# EAGLE board Resistor_Resistor (EAGLE 8.3.0), part 30 of 32
## Placement (x,y rotation side) (continued)
R36676  10K  [0201]  248.46,46.99 0 top
R36677  10K  [0201]  248.46,47.6 0 top
R36678  10K  [0201]  248.46,48.21 0 top
R36679  10K  [0201]  248.46,48.82 0 top
R36680  10K  [0201]  248.46,49.43 0 top
R36681  10K  [0201]  248.46,50.04 0 top
R36682  10K  [0201]  248.46,50.65 0 top
R36683  10K  [0201]  248.46,51.26 0 top
R36684  10K  [0201]  248.46,51.87 0 top
R36685  10K  [0201]  248.46,52.48 0 top
R36686  10K  [0201]  248.46,53.09 0 top
R36687  10K  [0201]  248.46,53.7 0 top
R36688  10K  [0201]  248.46,54.31 0 top
R36689  10K  [0201]  248.46,54.91 0 top
R36690  10K  [0201]  248.46,55.52 0 top
R36691  10K  [0201]  248.46,56.13 0 top
R36692  10K  [0201]  248.46,56.74 0 top
R36693  10K  [0201]  248.46,57.35 0 top
R36694  10K  [0201]  248.46,57.96 0 top
R36695  10K  [0201]  248.46,58.57 0 top
R36696  10K  [0201]  248.46,59.18 0 top
R36697  10K  [0201]  248.46,59.79 0 top
R36698  10K  [0201]  248.46,60.4 0 top
R36699  10K  [0201]  248.46,61.01 0 top
R36700  10K  [0201]  248.46,61.62 0 top
R36701  10K  [0201]  248.46,62.23 0 top
R36702  10K  [0201]  248.46,62.84 0 top
R36703  10K  [0201]  248.46,63.45 0 top
R36704  10K  [0201]  248.46,64.06 0 top
R36705  10K  [0201]  248.46,64.67 0 top
R36706  10K  [0201]  248.46,65.28 0 top
R36707  10K  [0201]  248.46,65.89 0 top
R36708  10K  [0201]  248.46,66.5 0 top
R36709  10K  [0201]  248.46,67.11 0 top
R36710  10K  [0201]  248.46,67.72 0 top
R36711  10K  [0201]  248.46,68.33 0 top
R36712  10K  [0201]  248.46,68.94 0 top
R36713  10K  [0201]  248.46,69.55 0 top
R36714  10K  [0201]  248.46,70.15 0 top
R36715  10K  [0201]  248.46,70.76 0 top
R36716  10K  [0201]  248.46,71.37 0 top
R36717  10K  [0201]  248.46,71.98 0 top
R36718  10K  [0201]  248.46,72.59 0 top
R36719  10K  [0201]  248.46,73.2 0 top
R36720  10K  [0201]  248.46,73.81 0 top
R36721  10K  [0201]  248.46,74.42 0 top
R36722  10K  [0201]  248.46,75.03 0 top
R36723  10K  [0201]  248.46,75.64 0 top
R36724  10K  [0201]  248.46,76.25 0 top
R36725  10K  [0201]  248.46,76.86 0 top
R36726  10K  [0201]  248.46,77.47 0 top
R36727  10K  [0201]  248.46,78.08 0 top
R36728  10K  [0201]  248.46,78.69 0 top
R36729  10K  [0201]  248.46,79.3 0 top
R36730  10K  [0201]  248.46,79.91 0 top
R36731  10K  [0201]  248.46,80.52 0 top
R36732  10K  [0201]  248.46,81.13 0 top
R36733  10K  [0201]  248.46,81.74 0 top
R36734  10K  [0201]  248.46,82.35 0 top
R36735  10K  [0201]  248.46,82.96 0 top
R36736  10K  [0201]  248.46,83.57 0 top
R36737  10K  [0201]  248.46,84.18 0 top
R36738  10K  [0201]  248.46,84.79 0 top
R36739  10K  [0201]  248.46,85.39 0 top
R36740  10K  [0201]  248.46,86 0 top
R36741  10K  [0201]  248.46,86.61 0 top
R36742  10K  [0201]  248.46,87.22 0 top
R36743  10K  [0201]  248.46,87.83 0 top
R36744  10K  [0201]  248.46,88.44 0 top
R36745  10K  [0201]  248.46,89.05 0 top
R36746  10K  [0201]  248.46,89.66 0 top
R36747  10K  [0201]  248.46,90.27 0 top
R36748  10K  [0201]  248.46,90.88 0 top
R36749  10K  [0201]  248.46,91.49 0 top
R36750  10K  [0201]  248.46,92.1 0 top
R36751  10K  [0201]  248.46,92.71 0 top
R36752  10K  [0201]  248.46,93.32 0 top
R36753  10K  [0201]  248.46,93.93 0 top
R36754  10K  [0201]  248.46,94.54 0 top
R36755  10K  [0201]  248.46,95.15 0 top
R36756  10K  [0201]  248.46,95.76 0 top
R36757  10K  [0201]  248.46,96.37 0 top
R36758  10K  [0201]  248.46,96.98 0 top
R36759  10K  [0201]  248.46,97.59 0 top
R36760  10K  [0201]  248.46,98.2 0 top
R36761  10K  [0201]  248.46,98.81 0 top
R36762  10K  [0201]  248.46,99.42 0 top
R36763  10K  [0201]  248.46,100.03 0 top
R36764  10K  [0201]  248.46,100.63 0 top
R36765  10K  [0201]  248.46,101.24 0 top
R36766  10K  [0201]  248.46,101.85 0 top
R36767  10K  [0201]  248.46,102.46 0 top
R36768  10K  [0201]  248.46,103.07 0 top
R36769  10K  [0201]  248.46,103.68 0 top
R36770  10K  [0201]  248.46,104.29 0 top
R36771  10K  [0201]  248.46,104.9 0 top
R36772  10K  [0201]  248.46,105.51 0 top
R36773  10K  [0201]  248.46,106.12 0 top
R36774  10K  [0201]  248.46,106.73 0 top
R36775  10K  [0201]  248.46,107.34 0 top
R36776  10K  [0201]  248.46,107.95 0 top
R36777  10K  [0201]  248.46,108.56 0 top
R36778  10K  [0201]  248.46,109.17 0 top
R36779  10K  [0201]  248.46,109.78 0 top
R36780  10K  [0201]  248.46,110.39 0 top
R36781  10K  [0201]  248.46,111 0 top
R36782  10K  [0201]  248.46,111.61 0 top
R36783  10K  [0201]  248.46,112.22 0 top
R36784  10K  [0201]  248.46,112.83 0 top
R36785  10K  [0201]  248.46,113.44 0 top
R36786  10K  [0201]  248.46,114.05 0 top
R36787  10K  [0201]  248.46,114.66 0 top
R36788  10K  [0201]  248.46,115.27 0 top
R36789  10K  [0201]  248.46,115.87 0 top
R36790  10K  [0201]  248.46,116.48 0 top
R36791  10K  [0201]  248.46,117.09 0 top
R36792  10K  [0201]  248.46,117.7 0 top
R36793  10K  [0201]  248.46,118.31 0 top
R36794  10K  [0201]  248.46,118.92 0 top
R36795  10K  [0201]  248.46,119.53 0 top
R36796  10K  [0201]  248.46,120.14 0 top
R36797  10K  [0201]  248.46,120.75 0 top
R36798  10K  [0201]  248.46,121.36 0 top
R36799  10K  [0201]  248.46,121.97 0 top
R36800  10K  [0201]  248.46,122.58 0 top
R36801  10K  [0201]  249.68,1.27 0 top
R36802  10K  [0201]  249.68,1.88 0 top
R36803  10K  [0201]  249.68,2.49 0 top
R36804  10K  [0201]  249.68,3.1 0 top
R36805  10K  [0201]  249.68,3.71 0 top
R36806  10K  [0201]  249.68,4.32 0 top
R36807  10K  [0201]  249.68,4.93 0 top
R36808  10K  [0201]  249.68,5.54 0 top
R36809  10K  [0201]  249.68,6.15 0 top
R36810  10K  [0201]  249.68,6.76 0 top
R36811  10K  [0201]  249.68,7.37 0 top
R36812  10K  [0201]  249.68,7.98 0 top
R36813  10K  [0201]  249.68,8.59 0 top
R36814  10K  [0201]  249.68,9.19 0 top
R36815  10K  [0201]  249.68,9.8 0 top
R36816  10K  [0201]  249.68,10.41 0 top
R36817  10K  [0201]  249.68,11.02 0 top
R36818  10K  [0201]  249.68,11.63 0 top
R36819  10K  [0201]  249.68,12.24 0 top
R36820  10K  [0201]  249.68,12.85 0 top
R36821  10K  [0201]  249.68,13.46 0 top
R36822  10K  [0201]  249.68,14.07 0 top
R36823  10K  [0201]  249.68,14.68 0 top
R36824  10K  [0201]  249.68,15.29 0 top
R36825  10K  [0201]  249.68,15.9 0 top
R36826  10K  [0201]  249.68,16.51 0 top
R36827  10K  [0201]  249.68,17.12 0 top
R36828  10K  [0201]  249.68,17.73 0 top
R36829  10K  [0201]  249.68,18.34 0 top
R36830  10K  [0201]  249.68,18.95 0 top
R36831  10K  [0201]  249.68,19.56 0 top
R36832  10K  [0201]  249.68,20.17 0 top
R36833  10K  [0201]  249.68,20.78 0 top
R36834  10K  [0201]  249.68,21.39 0 top
R36835  10K  [0201]  249.68,22 0 top
R36836  10K  [0201]  249.68,22.61 0 top
R36837  10K  [0201]  249.68,23.22 0 top
R36838  10K  [0201]  249.68,23.83 0 top
R36839  10K  [0201]  249.68,24.43 0 top
R36840  10K  [0201]  249.68,25.04 0 top
R36841  10K  [0201]  249.68,25.65 0 top
R36842  10K  [0201]  249.68,26.26 0 top
R36843  10K  [0201]  249.68,26.87 0 top
R36844  10K  [0201]  249.68,27.48 0 top
R36845  10K  [0201]  249.68,28.09 0 top
R36846  10K  [0201]  249.68,28.7 0 top
R36847  10K  [0201]  249.68,29.31 0 top
R36848  10K  [0201]  249.68,29.92 0 top
R36849  10K  [0201]  249.68,30.53 0 top
R36850  10K  [0201]  249.68,31.14 0 top
R36851  10K  [0201]  249.68,31.75 0 top
R36852  10K  [0201]  249.68,32.36 0 top
R36853  10K  [0201]  249.68,32.97 0 top
R36854  10K  [0201]  249.68,33.58 0 top
R36855  10K  [0201]  249.68,34.19 0 top
R36856  10K  [0201]  249.68,34.8 0 top
R36857  10K  [0201]  249.68,35.41 0 top
R36858  10K  [0201]  249.68,36.02 0 top
R36859  10K  [0201]  249.68,36.63 0 top
R36860  10K  [0201]  249.68,37.24 0 top
R36861  10K  [0201]  249.68,37.85 0 top
R36862  10K  [0201]  249.68,38.46 0 top
R36863  10K  [0201]  249.68,39.07 0 top
R36864  10K  [0201]  249.68,39.67 0 top
R36865  10K  [0201]  249.68,40.28 0 top
R36866  10K  [0201]  249.68,40.89 0 top
R36867  10K  [0201]  249.68,41.5 0 top
R36868  10K  [0201]  249.68,42.11 0 top
R36869  10K  [0201]  249.68,42.72 0 top
R36870  10K  [0201]  249.68,43.33 0 top
R36871  10K  [0201]  249.68,43.94 0 top
R36872  10K  [0201]  249.68,44.55 0 top
R36873  10K  [0201]  249.68,45.16 0 top
R36874  10K  [0201]  249.68,45.77 0 top
R36875  10K  [0201]  249.68,46.38 0 top
R36876  10K  [0201]  249.68,46.99 0 top
R36877  10K  [0201]  249.68,47.6 0 top
R36878  10K  [0201]  249.68,48.21 0 top
R36879  10K  [0201]  249.68,48.82 0 top
R36880  10K  [0201]  249.68,49.43 0 top
R36881  10K  [0201]  249.68,50.04 0 top
R36882  10K  [0201]  249.68,50.65 0 top
R36883  10K  [0201]  249.68,51.26 0 top
R36884  10K  [0201]  249.68,51.87 0 top
R36885  10K  [0201]  249.68,52.48 0 top
R36886  10K  [0201]  249.68,53.09 0 top
R36887  10K  [0201]  249.68,53.7 0 top
R36888  10K  [0201]  249.68,54.31 0 top
R36889  10K  [0201]  249.68,54.91 0 top
R36890  10K  [0201]  249.68,55.52 0 top
R36891  10K  [0201]  249.68,56.13 0 top
R36892  10K  [0201]  249.68,56.74 0 top
R36893  10K  [0201]  249.68,57.35 0 top
R36894  10K  [0201]  249.68,57.96 0 top
R36895  10K  [0201]  249.68,58.57 0 top
R36896  10K  [0201]  249.68,59.18 0 top
R36897  10K  [0201]  249.68,59.79 0 top
R36898  10K  [0201]  249.68,60.4 0 top
R36899  10K  [0201]  249.68,61.01 0 top
R36900  10K  [0201]  249.68,61.62 0 top
R36901  10K  [0201]  249.68,62.23 0 top
R36902  10K  [0201]  249.68,62.84 0 top
R36903  10K  [0201]  249.68,63.45 0 top
R36904  10K  [0201]  249.68,64.06 0 top
R36905  10K  [0201]  249.68,64.67 0 top
R36906  10K  [0201]  249.68,65.28 0 top
R36907  10K  [0201]  249.68,65.89 0 top
R36908  10K  [0201]  249.68,66.5 0 top
R36909  10K  [0201]  249.68,67.11 0 top
R36910  10K  [0201]  249.68,67.72 0 top
R36911  10K  [0201]  249.68,68.33 0 top
R36912  10K  [0201]  249.68,68.94 0 top
R36913  10K  [0201]  249.68,69.55 0 top
R36914  10K  [0201]  249.68,70.15 0 top
R36915  10K  [0201]  249.68,70.76 0 top
R36916  10K  [0201]  249.68,71.37 0 top
R36917  10K  [0201]  249.68,71.98 0 top
R36918  10K  [0201]  249.68,72.59 0 top
R36919  10K  [0201]  249.68,73.2 0 top
R36920  10K  [0201]  249.68,73.81 0 top
R36921  10K  [0201]  249.68,74.42 0 top
R36922  10K  [0201]  249.68,75.03 0 top
R36923  10K  [0201]  249.68,75.64 0 top
R36924  10K  [0201]  249.68,76.25 0 top
R36925  10K  [0201]  249.68,76.86 0 top
R36926  10K  [0201]  249.68,77.47 0 top
R36927  10K  [0201]  249.68,78.08 0 top
R36928  10K  [0201]  249.68,78.69 0 top
R36929  10K  [0201]  249.68,79.3 0 top
R36930  10K  [0201]  249.68,79.91 0 top
R36931  10K  [0201]  249.68,80.52 0 top
R36932  10K  [0201]  249.68,81.13 0 top
R36933  10K  [0201]  249.68,81.74 0 top
R36934  10K  [0201]  249.68,82.35 0 top
R36935  10K  [0201]  249.68,82.96 0 top
R36936  10K  [0201]  249.68,83.57 0 top
R36937  10K  [0201]  249.68,84.18 0 top
R36938  10K  [0201]  249.68,84.79 0 top
R36939  10K  [0201]  249.68,85.39 0 top
R36940  10K  [0201]  249.68,86 0 top
R36941  10K  [0201]  249.68,86.61 0 top
R36942  10K  [0201]  249.68,87.22 0 top
R36943  10K  [0201]  249.68,87.83 0 top
R36944  10K  [0201]  249.68,88.44 0 top
R36945  10K  [0201]  249.68,89.05 0 top
R36946  10K  [0201]  249.68,89.66 0 top
R36947  10K  [0201]  249.68,90.27 0 top
R36948  10K  [0201]  249.68,90.88 0 top
R36949  10K  [0201]  249.68,91.49 0 top
R36950  10K  [0201]  249.68,92.1 0 top
R36951  10K  [0201]  249.68,92.71 0 top
R36952  10K  [0201]  249.68,93.32 0 top
R36953  10K  [0201]  249.68,93.93 0 top
R36954  10K  [0201]  249.68,94.54 0 top
R36955  10K  [0201]  249.68,95.15 0 top
R36956  10K  [0201]  249.68,95.76 0 top
R36957  10K  [0201]  249.68,96.37 0 top
R36958  10K  [0201]  249.68,96.98 0 top
R36959  10K  [0201]  249.68,97.59 0 top
R36960  10K  [0201]  249.68,98.2 0 top
R36961  10K  [0201]  249.68,98.81 0 top
R36962  10K  [0201]  249.68,99.42 0 top
R36963  10K  [0201]  249.68,100.03 0 top
R36964  10K  [0201]  249.68,100.63 0 top
R36965  10K  [0201]  249.68,101.24 0 top
R36966  10K  [0201]  249.68,101.85 0 top
R36967  10K  [0201]  249.68,102.46 0 top
R36968  10K  [0201]  249.68,103.07 0 top
R36969  10K  [0201]  249.68,103.68 0 top
R36970  10K  [0201]  249.68,104.29 0 top
R36971  10K  [0201]  249.68,104.9 0 top
R36972  10K  [0201]  249.68,105.51 0 top
R36973  10K  [0201]  249.68,106.12 0 top
R36974  10K  [0201]  249.68,106.73 0 top
R36975  10K  [0201]  249.68,107.34 0 top
R36976  10K  [0201]  249.68,107.95 0 top
R36977  10K  [0201]  249.68,108.56 0 top
R36978  10K  [0201]  249.68,109.17 0 top
R36979  10K  [0201]  249.68,109.78 0 top
R36980  10K  [0201]  249.68,110.39 0 top
R36981  10K  [0201]  249.68,111 0 top
R36982  10K  [0201]  249.68,111.61 0 top
R36983  10K  [0201]  249.68,112.22 0 top
R36984  10K  [0201]  249.68,112.83 0 top
R36985  10K  [0201]  249.68,113.44 0 top
R36986  10K  [0201]  249.68,114.05 0 top
R36987  10K  [0201]  249.68,114.66 0 top
R36988  10K  [0201]  249.68,115.27 0 top
R36989  10K  [0201]  249.68,115.87 0 top
R36990  10K  [0201]  249.68,116.48 0 top
R36991  10K  [0201]  249.68,117.09 0 top
R36992  10K  [0201]  249.68,117.7 0 top
R36993  10K  [0201]  249.68,118.31 0 top
R36994  10K  [0201]  249.68,118.92 0 top
R36995  10K  [0201]  249.68,119.53 0 top
R36996  10K  [0201]  249.68,120.14 0 top
R36997  10K  [0201]  249.68,120.75 0 top
R36998  10K  [0201]  249.68,121.36 0 top
R36999  10K  [0201]  249.68,121.97 0 top
R37000  10K  [0201]  249.68,122.58 0 top
R37001  10K  [0201]  250.9,1.27 0 top
R37002  10K  [0201]  250.9,1.88 0 top
R37003  10K  [0201]  250.9,2.49 0 top
R37004  10K  [0201]  250.9,3.1 0 top
R37005  10K  [0201]  250.9,3.71 0 top
R37006  10K  [0201]  250.9,4.32 0 top
R37007  10K  [0201]  250.9,4.93 0 top
R37008  10K  [0201]  250.9,5.54 0 top
R37009  10K  [0201]  250.9,6.15 0 top
R37010  10K  [0201]  250.9,6.76 0 top
R37011  10K  [0201]  250.9,7.37 0 top
R37012  10K  [0201]  250.9,7.98 0 top
R37013  10K  [0201]  250.9,8.59 0 top
R37014  10K  [0201]  250.9,9.19 0 top
R37015  10K  [0201]  250.9,9.8 0 top
R37016  10K  [0201]  250.9,10.41 0 top
R37017  10K  [0201]  250.9,11.02 0 top
R37018  10K  [0201]  250.9,11.63 0 top
R37019  10K  [0201]  250.9,12.24 0 top
R37020  10K  [0201]  250.9,12.85 0 top
R37021  10K  [0201]  250.9,13.46 0 top
R37022  10K  [0201]  250.9,14.07 0 top
R37023  10K  [0201]  250.9,14.68 0 top
R37024  10K  [0201]  250.9,15.29 0 top
R37025  10K  [0201]  250.9,15.9 0 top
R37026  10K  [0201]  250.9,16.51 0 top
R37027  10K  [0201]  250.9,17.12 0 top
R37028  10K  [0201]  250.9,17.73 0 top
R37029  10K  [0201]  250.9,18.34 0 top
R37030  10K  [0201]  250.9,18.95 0 top
R37031  10K  [0201]  250.9,19.56 0 top
R37032  10K  [0201]  250.9,20.17 0 top
R37033  10K  [0201]  250.9,20.78 0 top
R37034  10K  [0201]  250.9,21.39 0 top
R37035  10K  [0201]  250.9,22 0 top
R37036  10K  [0201]  250.9,22.61 0 top
R37037  10K  [0201]  250.9,23.22 0 top
R37038  10K  [0201]  250.9,23.83 0 top
R37039  10K  [0201]  250.9,24.43 0 top
R37040  10K  [0201]  250.9,25.04 0 top
R37041  10K  [0201]  250.9,25.65 0 top
R37042  10K  [0201]  250.9,26.26 0 top
R37043  10K  [0201]  250.9,26.87 0 top
R37044  10K  [0201]  250.9,27.48 0 top
R37045  10K  [0201]  250.9,28.09 0 top
R37046  10K  [0201]  250.9,28.7 0 top
R37047  10K  [0201]  250.9,29.31 0 top
R37048  10K  [0201]  250.9,29.92 0 top
R37049  10K  [0201]  250.9,30.53 0 top
R37050  10K  [0201]  250.9,31.14 0 top
R37051  10K  [0201]  250.9,31.75 0 top
R37052  10K  [0201]  250.9,32.36 0 top
R37053  10K  [0201]  250.9,32.97 0 top
R37054  10K  [0201]  250.9,33.58 0 top
R37055  10K  [0201]  250.9,34.19 0 top
R37056  10K  [0201]  250.9,34.8 0 top
R37057  10K  [0201]  250.9,35.41 0 top
R37058  10K  [0201]  250.9,36.02 0 top
R37059  10K  [0201]  250.9,36.63 0 top
R37060  10K  [0201]  250.9,37.24 0 top
R37061  10K  [0201]  250.9,37.85 0 top
R37062  10K  [0201]  250.9,38.46 0 top
R37063  10K  [0201]  250.9,39.07 0 top
R37064  10K  [0201]  250.9,39.67 0 top
R37065  10K  [0201]  250.9,40.28 0 top
R37066  10K  [0201]  250.9,40.89 0 top
R37067  10K  [0201]  250.9,41.5 0 top
R37068  10K  [0201]  250.9,42.11 0 top
R37069  10K  [0201]  250.9,42.72 0 top
R37070  10K  [0201]  250.9,43.33 0 top
R37071  10K  [0201]  250.9,43.94 0 top
R37072  10K  [0201]  250.9,44.55 0 top
R37073  10K  [0201]  250.9,45.16 0 top
R37074  10K  [0201]  250.9,45.77 0 top
R37075  10K  [0201]  250.9,46.38 0 top
R37076  10K  [0201]  250.9,46.99 0 top
R37077  10K  [0201]  250.9,47.6 0 top
R37078  10K  [0201]  250.9,48.21 0 top
R37079  10K  [0201]  250.9,48.82 0 top
R37080  10K  [0201]  250.9,49.43 0 top
R37081  10K  [0201]  250.9,50.04 0 top
R37082  10K  [0201]  250.9,50.65 0 top
R37083  10K  [0201]  250.9,51.26 0 top
R37084  10K  [0201]  250.9,51.87 0 top
R37085  10K  [0201]  250.9,52.48 0 top
R37086  10K  [0201]  250.9,53.09 0 top
R37087  10K  [0201]  250.9,53.7 0 top
R37088  10K  [0201]  250.9,54.31 0 top
R37089  10K  [0201]  250.9,54.91 0 top
R37090  10K  [0201]  250.9,55.52 0 top
R37091  10K  [0201]  250.9,56.13 0 top
R37092  10K  [0201]  250.9,56.74 0 top
R37093  10K  [0201]  250.9,57.35 0 top
R37094  10K  [0201]  250.9,57.96 0 top
R37095  10K  [0201]  250.9,58.57 0 top
R37096  10K  [0201]  250.9,59.18 0 top
R37097  10K  [0201]  250.9,59.79 0 top
R37098  10K  [0201]  250.9,60.4 0 top
R37099  10K  [0201]  250.9,61.01 0 top
R37100  10K  [0201]  250.9,61.62 0 top
R37101  10K  [0201]  250.9,62.23 0 top
R37102  10K  [0201]  250.9,62.84 0 top
R37103  10K  [0201]  250.9,63.45 0 top
R37104  10K  [0201]  250.9,64.06 0 top
R37105  10K  [0201]  250.9,64.67 0 top
R37106  10K  [0201]  250.9,65.28 0 top
R37107  10K  [0201]  250.9,65.89 0 top
R37108  10K  [0201]  250.9,66.5 0 top
R37109  10K  [0201]  250.9,67.11 0 top
R37110  10K  [0201]  250.9,67.72 0 top
R37111  10K  [0201]  250.9,68.33 0 top
R37112  10K  [0201]  250.9,68.94 0 top
R37113  10K  [0201]  250.9,69.55 0 top
R37114  10K  [0201]  250.9,70.15 0 top
R37115  10K  [0201]  250.9,70.76 0 top
R37116  10K  [0201]  250.9,71.37 0 top
R37117  10K  [0201]  250.9,71.98 0 top
R37118  10K  [0201]  250.9,72.59 0 top
R37119  10K  [0201]  250.9,73.2 0 top
R37120  10K  [0201]  250.9,73.81 0 top
R37121  10K  [0201]  250.9,74.42 0 top
R37122  10K  [0201]  250.9,75.03 0 top
R37123  10K  [0201]  250.9,75.64 0 top
R37124  10K  [0201]  250.9,76.25 0 top
R37125  10K  [0201]  250.9,76.86 0 top
R37126  10K  [0201]  250.9,77.47 0 top
R37127  10K  [0201]  250.9,78.08 0 top
R37128  10K  [0201]  250.9,78.69 0 top
R37129  10K  [0201]  250.9,79.3 0 top
R37130  10K  [0201]  250.9,79.91 0 top
R37131  10K  [0201]  250.9,80.52 0 top
R37132  10K  [0201]  250.9,81.13 0 top
R37133  10K  [0201]  250.9,81.74 0 top
R37134  10K  [0201]  250.9,82.35 0 top
R37135  10K  [0201]  250.9,82.96 0 top
R37136  10K  [0201]  250.9,83.57 0 top
R37137  10K  [0201]  250.9,84.18 0 top
R37138  10K  [0201]  250.9,84.79 0 top
R37139  10K  [0201]  250.9,85.39 0 top
R37140  10K  [0201]  250.9,86 0 top
R37141  10K  [0201]  250.9,86.61 0 top
R37142  10K  [0201]  250.9,87.22 0 top
R37143  10K  [0201]  250.9,87.83 0 top
R37144  10K  [0201]  250.9,88.44 0 top
R37145  10K  [0201]  250.9,89.05 0 top
R37146  10K  [0201]  250.9,89.66 0 top
R37147  10K  [0201]  250.9,90.27 0 top
R37148  10K  [0201]  250.9,90.88 0 top
R37149  10K  [0201]  250.9,91.49 0 top
R37150  10K  [0201]  250.9,92.1 0 top
R37151  10K  [0201]  250.9,92.71 0 top
R37152  10K  [0201]  250.9,93.32 0 top
R37153  10K  [0201]  250.9,93.93 0 top
R37154  10K  [0201]  250.9,94.54 0 top
R37155  10K  [0201]  250.9,95.15 0 top
R37156  10K  [0201]  250.9,95.76 0 top
R37157  10K  [0201]  250.9,96.37 0 top
R37158  10K  [0201]  250.9,96.98 0 top
R37159  10K  [0201]  250.9,97.59 0 top
R37160  10K  [0201]  250.9,98.2 0 top
R37161  10K  [0201]  250.9,98.81 0 top
R37162  10K  [0201]  250.9,99.42 0 top
R37163  10K  [0201]  250.9,100.03 0 top
R37164  10K  [0201]  250.9,100.63 0 top
R37165  10K  [0201]  250.9,101.24 0 top
R37166  10K  [0201]  250.9,101.85 0 top
R37167  10K  [0201]  250.9,102.46 0 top
R37168  10K  [0201]  250.9,103.07 0 top
R37169  10K  [0201]  250.9,103.68 0 top
R37170  10K  [0201]  250.9,104.29 0 top
R37171  10K  [0201]  250.9,104.9 0 top
R37172  10K  [0201]  250.9,105.51 0 top
R37173  10K  [0201]  250.9,106.12 0 top
R37174  10K  [0201]  250.9,106.73 0 top
R37175  10K  [0201]  250.9,107.34 0 top
R37176  10K  [0201]  250.9,107.95 0 top
R37177  10K  [0201]  250.9,108.56 0 top
R37178  10K  [0201]  250.9,109.17 0 top
R37179  10K  [0201]  250.9,109.78 0 top
R37180  10K  [0201]  250.9,110.39 0 top
R37181  10K  [0201]  250.9,111 0 top
R37182  10K  [0201]  250.9,111.61 0 top
R37183  10K  [0201]  250.9,112.22 0 top
R37184  10K  [0201]  250.9,112.83 0 top
R37185  10K  [0201]  250.9,113.44 0 top
R37186  10K  [0201]  250.9,114.05 0 top
R37187  10K  [0201]  250.9,114.66 0 top
R37188  10K  [0201]  250.9,115.27 0 top
R37189  10K  [0201]  250.9,115.87 0 top
R37190  10K  [0201]  250.9,116.48 0 top
R37191  10K  [0201]  250.9,117.09 0 top
R37192  10K  [0201]  250.9,117.7 0 top
R37193  10K  [0201]  250.9,118.31 0 top
R37194  10K  [0201]  250.9,118.92 0 top
R37195  10K  [0201]  250.9,119.53 0 top
R37196  10K  [0201]  250.9,120.14 0 top
R37197  10K  [0201]  250.9,120.75 0 top
R37198  10K  [0201]  250.9,121.36 0 top
R37199  10K  [0201]  250.9,121.97 0 top
R37200  10K  [0201]  250.9,122.58 0 top
R37201  10K  [0201]  252.12,1.27 0 top
R37202  10K  [0201]  252.12,1.88 0 top
R37203  10K  [0201]  252.12,2.49 0 top
R37204  10K  [0201]  252.12,3.1 0 top
R37205  10K  [0201]  252.12,3.71 0 top
R37206  10K  [0201]  252.12,4.32 0 top
R37207  10K  [0201]  252.12,4.93 0 top
R37208  10K  [0201]  252.12,5.54 0 top
R37209  10K  [0201]  252.12,6.15 0 top
R37210  10K  [0201]  252.12,6.76 0 top
R37211  10K  [0201]  252.12,7.37 0 top
R37212  10K  [0201]  252.12,7.98 0 top
R37213  10K  [0201]  252.12,8.59 0 top
R37214  10K  [0201]  252.12,9.19 0 top
R37215  10K  [0201]  252.12,9.8 0 top
R37216  10K  [0201]  252.12,10.41 0 top
R37217  10K  [0201]  252.12,11.02 0 top
R37218  10K  [0201]  252.12,11.63 0 top
R37219  10K  [0201]  252.12,12.24 0 top
R37220  10K  [0201]  252.12,12.85 0 top
R37221  10K  [0201]  252.12,13.46 0 top
R37222  10K  [0201]  252.12,14.07 0 top
R37223  10K  [0201]  252.12,14.68 0 top
R37224  10K  [0201]  252.12,15.29 0 top
R37225  10K  [0201]  252.12,15.9 0 top
R37226  10K  [0201]  252.12,16.51 0 top
R37227  10K  [0201]  252.12,17.12 0 top
R37228  10K  [0201]  252.12,17.73 0 top
R37229  10K  [0201]  252.12,18.34 0 top
R37230  10K  [0201]  252.12,18.95 0 top
R37231  10K  [0201]  252.12,19.56 0 top
R37232  10K  [0201]  252.12,20.17 0 top
R37233  10K  [0201]  252.12,20.78 0 top
R37234  10K  [0201]  252.12,21.39 0 top
R37235  10K  [0201]  252.12,22 0 top
R37236  10K  [0201]  252.12,22.61 0 top
R37237  10K  [0201]  252.12,23.22 0 top
R37238  10K  [0201]  252.12,23.83 0 top
R37239  10K  [0201]  252.12,24.43 0 top
R37240  10K  [0201]  252.12,25.04 0 top
R37241  10K  [0201]  252.12,25.65 0 top
R37242  10K  [0201]  252.12,26.26 0 top
R37243  10K  [0201]  252.12,26.87 0 top
R37244  10K  [0201]  252.12,27.48 0 top
R37245  10K  [0201]  252.12,28.09 0 top
R37246  10K  [0201]  252.12,28.7 0 top
R37247  10K  [0201]  252.12,29.31 0 top
R37248  10K  [0201]  252.12,29.92 0 top
R37249  10K  [0201]  252.12,30.53 0 top
R37250  10K  [0201]  252.12,31.14 0 top
R37251  10K  [0201]  252.12,31.75 0 top
R37252  10K  [0201]  252.12,32.36 0 top
R37253  10K  [0201]  252.12,32.97 0 top
R37254  10K  [0201]  252.12,33.58 0 top
R37255  10K  [0201]  252.12,34.19 0 top
R37256  10K  [0201]  252.12,34.8 0 top
R37257  10K  [0201]  252.12,35.41 0 top
R37258  10K  [0201]  252.12,36.02 0 top
R37259  10K  [0201]  252.12,36.63 0 top
R37260  10K  [0201]  252.12,37.24 0 top
R37261  10K  [0201]  252.12,37.85 0 top
R37262  10K  [0201]  252.12,38.46 0 top
R37263  10K  [0201]  252.12,39.07 0 top
R37264  10K  [0201]  252.12,39.67 0 top
R37265  10K  [0201]  252.12,40.28 0 top
R37266  10K  [0201]  252.12,40.89 0 top
R37267  10K  [0201]  252.12,41.5 0 top
R37268  10K  [0201]  252.12,42.11 0 top
R37269  10K  [0201]  252.12,42.72 0 top
R37270  10K  [0201]  252.12,43.33 0 top
R37271  10K  [0201]  252.12,43.94 0 top
R37272  10K  [0201]  252.12,44.55 0 top
R37273  10K  [0201]  252.12,45.16 0 top
R37274  10K  [0201]  252.12,45.77 0 top
R37275  10K  [0201]  252.12,46.38 0 top
R37276  10K  [0201]  252.12,46.99 0 top
R37277  10K  [0201]  252.12,47.6 0 top
R37278  10K  [0201]  252.12,48.21 0 top
R37279  10K  [0201]  252.12,48.82 0 top
R37280  10K  [0201]  252.12,49.43 0 top
R37281  10K  [0201]  252.12,50.04 0 top
R37282  10K  [0201]  252.12,50.65 0 top
R37283  10K  [0201]  252.12,51.26 0 top
R37284  10K  [0201]  252.12,51.87 0 top
R37285  10K  [0201]  252.12,52.48 0 top
R37286  10K  [0201]  252.12,53.09 0 top
R37287  10K  [0201]  252.12,53.7 0 top
R37288  10K  [0201]  252.12,54.31 0 top
R37289  10K  [0201]  252.12,54.91 0 top
R37290  10K  [0201]  252.12,55.52 0 top
R37291  10K  [0201]  252.12,56.13 0 top
R37292  10K  [0201]  252.12,56.74 0 top
R37293  10K  [0201]  252.12,57.35 0 top
R37294  10K  [0201]  252.12,57.96 0 top
R37295  10K  [0201]  252.12,58.57 0 top
R37296  10K  [0201]  252.12,59.18 0 top
R37297  10K  [0201]  252.12,59.79 0 top
R37298  10K  [0201]  252.12,60.4 0 top
R37299  10K  [0201]  252.12,61.01 0 top
R37300  10K  [0201]  252.12,61.62 0 top
R37301  10K  [0201]  252.12,62.23 0 top
R37302  10K  [0201]  252.12,62.84 0 top
R37303  10K  [0201]  252.12,63.45 0 top
R37304  10K  [0201]  252.12,64.06 0 top
R37305  10K  [0201]  252.12,64.67 0 top
R37306  10K  [0201]  252.12,65.28 0 top
R37307  10K  [0201]  252.12,65.89 0 top
R37308  10K  [0201]  252.12,66.5 0 top
R37309  10K  [0201]  252.12,67.11 0 top
R37310  10K  [0201]  252.12,67.72 0 top
R37311  10K  [0201]  252.12,68.33 0 top
R37312  10K  [0201]  252.12,68.94 0 top
R37313  10K  [0201]  252.12,69.55 0 top
R37314  10K  [0201]  252.12,70.15 0 top
R37315  10K  [0201]  252.12,70.76 0 top
R37316  10K  [0201]  252.12,71.37 0 top
R37317  10K  [0201]  252.12,71.98 0 top
R37318  10K  [0201]  252.12,72.59 0 top
R37319  10K  [0201]  252.12,73.2 0 top
R37320  10K  [0201]  252.12,73.81 0 top
R37321  10K  [0201]  252.12,74.42 0 top
R37322  10K  [0201]  252.12,75.03 0 top
R37323  10K  [0201]  252.12,75.64 0 top
R37324  10K  [0201]  252.12,76.25 0 top
R37325  10K  [0201]  252.12,76.86 0 top
R37326  10K  [0201]  252.12,77.47 0 top
R37327  10K  [0201]  252.12,78.08 0 top
R37328  10K  [0201]  252.12,78.69 0 top
R37329  10K  [0201]  252.12,79.3 0 top
R37330  10K  [0201]  252.12,79.91 0 top
R37331  10K  [0201]  252.12,80.52 0 top
R37332  10K  [0201]  252.12,81.13 0 top
R37333  10K  [0201]  252.12,81.74 0 top
R37334  10K  [0201]  252.12,82.35 0 top
R37335  10K  [0201]  252.12,82.96 0 top
R37336  10K  [0201]  252.12,83.57 0 top
R37337  10K  [0201]  252.12,84.18 0 top
R37338  10K  [0201]  252.12,84.79 0 top
R37339  10K  [0201]  252.12,85.39 0 top
R37340  10K  [0201]  252.12,86 0 top
R37341  10K  [0201]  252.12,86.61 0 top
R37342  10K  [0201]  252.12,87.22 0 top
R37343  10K  [0201]  252.12,87.83 0 top
R37344  10K  [0201]  252.12,88.44 0 top
R37345  10K  [0201]  252.12,89.05 0 top
R37346  10K  [0201]  252.12,89.66 0 top
R37347  10K  [0201]  252.12,90.27 0 top
R37348  10K  [0201]  252.12,90.88 0 top
R37349  10K  [0201]  252.12,91.49 0 top
R37350  10K  [0201]  252.12,92.1 0 top
R37351  10K  [0201]  252.12,92.71 0 top
R37352  10K  [0201]  252.12,93.32 0 top
R37353  10K  [0201]  252.12,93.93 0 top
R37354  10K  [0201]  252.12,94.54 0 top
R37355  10K  [0201]  252.12,95.15 0 top
R37356  10K  [0201]  252.12,95.76 0 top
R37357  10K  [0201]  252.12,96.37 0 top
R37358  10K  [0201]  252.12,96.98 0 top
R37359  10K  [0201]  252.12,97.59 0 top
R37360  10K  [0201]  252.12,98.2 0 top
R37361  10K  [0201]  252.12,98.81 0 top
R37362  10K  [0201]  252.12,99.42 0 top
R37363  10K  [0201]  252.12,100.03 0 top
R37364  10K  [0201]  252.12,100.63 0 top
R37365  10K  [0201]  252.12,101.24 0 top
R37366  10K  [0201]  252.12,101.85 0 top
R37367  10K  [0201]  252.12,102.46 0 top
R37368  10K  [0201]  252.12,103.07 0 top
R37369  10K  [0201]  252.12,103.68 0 top
R37370  10K  [0201]  252.12,104.29 0 top
R37371  10K  [0201]  252.12,104.9 0 top
R37372  10K  [0201]  252.12,105.51 0 top
R37373  10K  [0201]  252.12,106.12 0 top
R37374  10K  [0201]  252.12,106.73 0 top
R37375  10K  [0201]  252.12,107.34 0 top
R37376  10K  [0201]  252.12,107.95 0 top
R37377  10K  [0201]  252.12,108.56 0 top
R37378  10K  [0201]  252.12,109.17 0 top
R37379  10K  [0201]  252.12,109.78 0 top
R37380  10K  [0201]  252.12,110.39 0 top
R37381  10K  [0201]  252.12,111 0 top
R37382  10K  [0201]  252.12,111.61 0 top
R37383  10K  [0201]  252.12,112.22 0 top
R37384  10K  [0201]  252.12,112.83 0 top
R37385  10K  [0201]  252.12,113.44 0 top
R37386  10K  [0201]  252.12,114.05 0 top
R37387  10K  [0201]  252.12,114.66 0 top
R37388  10K  [0201]  252.12,115.27 0 top
R37389  10K  [0201]  252.12,115.87 0 top
R37390  10K  [0201]  252.12,116.48 0 top
R37391  10K  [0201]  252.12,117.09 0 top
R37392  10K  [0201]  252.12,117.7 0 top
R37393  10K  [0201]  252.12,118.31 0 top
R37394  10K  [0201]  252.12,118.92 0 top
R37395  10K  [0201]  252.12,119.53 0 top
R37396  10K  [0201]  252.12,120.14 0 top
R37397  10K  [0201]  252.12,120.75 0 top
R37398  10K  [0201]  252.12,121.36 0 top
R37399  10K  [0201]  252.12,121.97 0 top
R37400  10K  [0201]  252.12,122.58 0 top
R37401  10K  [0201]  253.34,1.27 0 top
R37402  10K  [0201]  253.34,1.88 0 top
R37403  10K  [0201]  253.34,2.49 0 top
R37404  10K  [0201]  253.34,3.1 0 top
R37405  10K  [0201]  253.34,3.71 0 top
R37406  10K  [0201]  253.34,4.32 0 top
R37407  10K  [0201]  253.34,4.93 0 top
R37408  10K  [0201]  253.34,5.54 0 top
R37409  10K  [0201]  253.34,6.15 0 top
R37410  10K  [0201]  253.34,6.76 0 top
R37411  10K  [0201]  253.34,7.37 0 top
R37412  10K  [0201]  253.34,7.98 0 top
R37413  10K  [0201]  253.34,8.59 0 top
R37414  10K  [0201]  253.34,9.19 0 top
R37415  10K  [0201]  253.34,9.8 0 top
R37416  10K  [0201]  253.34,10.41 0 top
R37417  10K  [0201]  253.34,11.02 0 top
R37418  10K  [0201]  253.34,11.63 0 top
R37419  10K  [0201]  253.34,12.24 0 top
R37420  10K  [0201]  253.34,12.85 0 top
R37421  10K  [0201]  253.34,13.46 0 top
R37422  10K  [0201]  253.34,14.07 0 top
R37423  10K  [0201]  253.34,14.68 0 top
R37424  10K  [0201]  253.34,15.29 0 top
R37425  10K  [0201]  253.34,15.9 0 top
R37426  10K  [0201]  253.34,16.51 0 top
R37427  10K  [0201]  253.34,17.12 0 top
R37428  10K  [0201]  253.34,17.73 0 top
R37429  10K  [0201]  253.34,18.34 0 top
R37430  10K  [0201]  253.34,18.95 0 top
R37431  10K  [0201]  253.34,19.56 0 top
R37432  10K  [0201]  253.34,20.17 0 top
R37433  10K  [0201]  253.34,20.78 0 top
R37434  10K  [0201]  253.34,21.39 0 top
R37435  10K  [0201]  253.34,22 0 top
R37436  10K  [0201]  253.34,22.61 0 top
R37437  10K  [0201]  253.34,23.22 0 top
R37438  10K  [0201]  253.34,23.83 0 top
R37439  10K  [0201]  253.34,24.43 0 top
R37440  10K  [0201]  253.34,25.04 0 top
R37441  10K  [0201]  253.34,25.65 0 top
R37442  10K  [0201]  253.34,26.26 0 top
R37443  10K  [0201]  253.34,26.87 0 top
R37444  10K  [0201]  253.34,27.48 0 top
R37445  10K  [0201]  253.34,28.09 0 top
R37446  10K  [0201]  253.34,28.7 0 top
R37447  10K  [0201]  253.34,29.31 0 top
R37448  10K  [0201]  253.34,29.92 0 top
R37449  10K  [0201]  253.34,30.53 0 top
R37450  10K  [0201]  253.34,31.14 0 top
R37451  10K  [0201]  253.34,31.75 0 top
R37452  10K  [0201]  253.34,32.36 0 top
R37453  10K  [0201]  253.34,32.97 0 top
R37454  10K  [0201]  253.34,33.58 0 top
R37455  10K  [0201]  253.34,34.19 0 top
R37456  10K  [0201]  253.34,34.8 0 top
R37457  10K  [0201]  253.34,35.41 0 top
R37458  10K  [0201]  253.34,36.02 0 top
R37459  10K  [0201]  253.34,36.63 0 top
R37460  10K  [0201]  253.34,37.24 0 top
R37461  10K  [0201]  253.34,37.85 0 top
R37462  10K  [0201]  253.34,38.46 0 top
R37463  10K  [0201]  253.34,39.07 0 top
R37464  10K  [0201]  253.34,39.67 0 top
R37465  10K  [0201]  253.34,40.28 0 top
R37466  10K  [0201]  253.34,40.89 0 top
R37467  10K  [0201]  253.34,41.5 0 top
R37468  10K  [0201]  253.34,42.11 0 top
R37469  10K  [0201]  253.34,42.72 0 top
R37470  10K  [0201]  253.34,43.33 0 top
R37471  10K  [0201]  253.34,43.94 0 top
R37472  10K  [0201]  253.34,44.55 0 top
R37473  10K  [0201]  253.34,45.16 0 top
R37474  10K  [0201]  253.34,45.77 0 top
R37475  10K  [0201]  253.34,46.38 0 top
R37476  10K  [0201]  253.34,46.99 0 top
R37477  10K  [0201]  253.34,47.6 0 top
R37478  10K  [0201]  253.34,48.21 0 top
R37479  10K  [0201]  253.34,48.82 0 top
R37480  10K  [0201]  253.34,49.43 0 top
R37481  10K  [0201]  253.34,50.04 0 top
R37482  10K  [0201]  253.34,50.65 0 top
R37483  10K  [0201]  253.34,51.26 0 top
R37484  10K  [0201]  253.34,51.87 0 top
R37485  10K  [0201]  253.34,52.48 0 top
R37486  10K  [0201]  253.34,53.09 0 top
R37487  10K  [0201]  253.34,53.7 0 top
R37488  10K  [0201]  253.34,54.31 0 top
R37489  10K  [0201]  253.34,54.91 0 top
R37490  10K  [0201]  253.34,55.52 0 top
R37491  10K  [0201]  253.34,56.13 0 top
R37492  10K  [0201]  253.34,56.74 0 top
R37493  10K  [0201]  253.34,57.35 0 top
R37494  10K  [0201]  253.34,57.96 0 top
R37495  10K  [0201]  253.34,58.57 0 top
R37496  10K  [0201]  253.34,59.18 0 top
R37497  10K  [0201]  253.34,59.79 0 top
R37498  10K  [0201]  253.34,60.4 0 top
R37499  10K  [0201]  253.34,61.01 0 top
R37500  10K  [0201]  253.34,61.62 0 top
R37501  10K  [0201]  253.34,62.23 0 top
R37502  10K  [0201]  253.34,62.84 0 top
R37503  10K  [0201]  253.34,63.45 0 top
R37504  10K  [0201]  253.34,64.06 0 top
R37505  10K  [0201]  253.34,64.67 0 top
R37506  10K  [0201]  253.34,65.28 0 top
R37507  10K  [0201]  253.34,65.89 0 top
R37508  10K  [0201]  253.34,66.5 0 top
R37509  10K  [0201]  253.34,67.11 0 top
R37510  10K  [0201]  253.34,67.72 0 top
R37511  10K  [0201]  253.34,68.33 0 top
R37512  10K  [0201]  253.34,68.94 0 top
R37513  10K  [0201]  253.34,69.55 0 top
R37514  10K  [0201]  253.34,70.15 0 top
R37515  10K  [0201]  253.34,70.76 0 top
R37516  10K  [0201]  253.34,71.37 0 top
R37517  10K  [0201]  253.34,71.98 0 top
R37518  10K  [0201]  253.34,72.59 0 top
R37519  10K  [0201]  253.34,73.2 0 top
R37520  10K  [0201]  253.34,73.81 0 top
R37521  10K  [0201]  253.34,74.42 0 top
R37522  10K  [0201]  253.34,75.03 0 top
R37523  10K  [0201]  253.34,75.64 0 top
R37524  10K  [0201]  253.34,76.25 0 top
R37525  10K  [0201]  253.34,76.86 0 top
R37526  10K  [0201]  253.34,77.47 0 top
R37527  10K  [0201]  253.34,78.08 0 top
R37528  10K  [0201]  253.34,78.69 0 top
R37529  10K  [0201]  253.34,79.3 0 top
R37530  10K  [0201]  253.34,79.91 0 top
R37531  10K  [0201]  253.34,80.52 0 top
R37532  10K  [0201]  253.34,81.13 0 top
R37533  10K  [0201]  253.34,81.74 0 top
R37534  10K  [0201]  253.34,82.35 0 top
R37535  10K  [0201]  253.34,82.96 0 top
R37536  10K  [0201]  253.34,83.57 0 top
R37537  10K  [0201]  253.34,84.18 0 top
R37538  10K  [0201]  253.34,84.79 0 top
R37539  10K  [0201]  253.34,85.39 0 top
R37540  10K  [0201]  253.34,86 0 top
R37541  10K  [0201]  253.34,86.61 0 top
R37542  10K  [0201]  253.34,87.22 0 top
R37543  10K  [0201]  253.34,87.83 0 top
R37544  10K  [0201]  253.34,88.44 0 top
R37545  10K  [0201]  253.34,89.05 0 top
R37546  10K  [0201]  253.34,89.66 0 top
R37547  10K  [0201]  253.34,90.27 0 top
R37548  10K  [0201]  253.34,90.88 0 top
R37549  10K  [0201]  253.34,91.49 0 top
R37550  10K  [0201]  253.34,92.1 0 top
R37551  10K  [0201]  253.34,92.71 0 top
R37552  10K  [0201]  253.34,93.32 0 top
R37553  10K  [0201]  253.34,93.93 0 top
R37554  10K  [0201]  253.34,94.54 0 top
R37555  10K  [0201]  253.34,95.15 0 top
R37556  10K  [0201]  253.34,95.76 0 top
R37557  10K  [0201]  253.34,96.37 0 top
R37558  10K  [0201]  253.34,96.98 0 top
R37559  10K  [0201]  253.34,97.59 0 top
R37560  10K  [0201]  253.34,98.2 0 top
R37561  10K  [0201]  253.34,98.81 0 top
R37562  10K  [0201]  253.34,99.42 0 top
R37563  10K  [0201]  253.34,100.03 0 top
R37564  10K  [0201]  253.34,100.63 0 top
R37565  10K  [0201]  253.34,101.24 0 top
R37566  10K  [0201]  253.34,101.85 0 top
R37567  10K  [0201]  253.34,102.46 0 top
R37568  10K  [0201]  253.34,103.07 0 top
R37569  10K  [0201]  253.34,103.68 0 top
R37570  10K  [0201]  253.34,104.29 0 top
R37571  10K  [0201]  253.34,104.9 0 top
R37572  10K  [0201]  253.34,105.51 0 top
R37573  10K  [0201]  253.34,106.12 0 top
R37574  10K  [0201]  253.34,106.73 0 top
R37575  10K  [0201]  253.34,107.34 0 top
R37576  10K  [0201]  253.34,107.95 0 top
R37577  10K  [0201]  253.34,108.56 0 top
R37578  10K  [0201]  253.34,109.17 0 top
R37579  10K  [0201]  253.34,109.78 0 top
R37580  10K  [0201]  253.34,110.39 0 top
R37581  10K  [0201]  253.34,111 0 top
R37582  10K  [0201]  253.34,111.61 0 top
R37583  10K  [0201]  253.34,112.22 0 top
R37584  10K  [0201]  253.34,112.83 0 top
R37585  10K  [0201]  253.34,113.44 0 top
R37586  10K  [0201]  253.34,114.05 0 top
R37587  10K  [0201]  253.34,114.66 0 top
R37588  10K  [0201]  253.34,115.27 0 top
R37589  10K  [0201]  253.34,115.87 0 top
R37590  10K  [0201]  253.34,116.48 0 top
R37591  10K  [0201]  253.34,117.09 0 top
R37592  10K  [0201]  253.34,117.7 0 top
R37593  10K  [0201]  253.34,118.31 0 top
R37594  10K  [0201]  253.34,118.92 0 top
R37595  10K  [0201]  253.34,119.53 0 top
R37596  10K  [0201]  253.34,120.14 0 top
R37597  10K  [0201]  253.34,120.75 0 top
R37598  10K  [0201]  253.34,121.36 0 top
R37599  10K  [0201]  253.34,121.97 0 top
R37600  10K  [0201]  253.34,122.58 0 top
R37601  10K  [0201]  254.56,1.27 0 top
R37602  10K  [0201]  254.56,1.88 0 top
R37603  10K  [0201]  254.56,2.49 0 top
R37604  10K  [0201]  254.56,3.1 0 top
R37605  10K  [0201]  254.56,3.71 0 top
R37606  10K  [0201]  254.56,4.32 0 top
R37607  10K  [0201]  254.56,4.93 0 top
R37608  10K  [0201]  254.56,5.54 0 top
R37609  10K  [0201]  254.56,6.15 0 top
R37610  10K  [0201]  254.56,6.76 0 top
R37611  10K  [0201]  254.56,7.37 0 top
R37612  10K  [0201]  254.56,7.98 0 top
R37613  10K  [0201]  254.56,8.59 0 top
R37614  10K  [0201]  254.56,9.19 0 top
R37615  10K  [0201]  254.56,9.8 0 top
R37616  10K  [0201]  254.56,10.41 0 top
R37617  10K  [0201]  254.56,11.02 0 top
R37618  10K  [0201]  254.56,11.63 0 top
R37619  10K  [0201]  254.56,12.24 0 top
R37620  10K  [0201]  254.56,12.85 0 top
R37621  10K  [0201]  254.56,13.46 0 top
R37622  10K  [0201]  254.56,14.07 0 top
R37623  10K  [0201]  254.56,14.68 0 top
R37624  10K  [0201]  254.56,15.29 0 top
R37625  10K  [0201]  254.56,15.9 0 top
R37626  10K  [0201]  254.56,16.51 0 top
R37627  10K  [0201]  254.56,17.12 0 top
R37628  10K  [0201]  254.56,17.73 0 top
R37629  10K  [0201]  254.56,18.34 0 top
R37630  10K  [0201]  254.56,18.95 0 top
R37631  10K  [0201]  254.56,19.56 0 top
R37632  10K  [0201]  254.56,20.17 0 top
R37633  10K  [0201]  254.56,20.78 0 top
R37634  10K  [0201]  254.56,21.39 0 top
R37635  10K  [0201]  254.56,22 0 top
R37636  10K  [0201]  254.56,22.61 0 top
R37637  10K  [0201]  254.56,23.22 0 top
R37638  10K  [0201]  254.56,23.83 0 top
R37639  10K  [0201]  254.56,24.43 0 top
R37640  10K  [0201]  254.56,25.04 0 top
R37641  10K  [0201]  254.56,25.65 0 top
R37642  10K  [0201]  254.56,26.26 0 top
R37643  10K  [0201]  254.56,26.87 0 top
R37644  10K  [0201]  254.56,27.48 0 top
R37645  10K  [0201]  254.56,28.09 0 top
R37646  10K  [0201]  254.56,28.7 0 top
R37647  10K  [0201]  254.56,29.31 0 top
R37648  10K  [0201]  254.56,29.92 0 top
R37649  10K  [0201]  254.56,30.53 0 top
R37650  10K  [0201]  254.56,31.14 0 top
R37651  10K  [0201]  254.56,31.75 0 top
R37652  10K  [0201]  254.56,32.36 0 top
R37653  10K  [0201]  254.56,32.97 0 top
R37654  10K  [0201]  254.56,33.58 0 top
R37655  10K  [0201]  254.56,34.19 0 top
R37656  10K  [0201]  254.56,34.8 0 top
R37657  10K  [0201]  254.56,35.41 0 top
R37658  10K  [0201]  254.56,36.02 0 top
R37659  10K  [0201]  254.56,36.63 0 top
R37660  10K  [0201]  254.56,37.24 0 top
R37661  10K  [0201]  254.56,37.85 0 top
R37662  10K  [0201]  254.56,38.46 0 top
R37663  10K  [0201]  254.56,39.07 0 top
R37664  10K  [0201]  254.56,39.67 0 top
R37665  10K  [0201]  254.56,40.28 0 top
R37666  10K  [0201]  254.56,40.89 0 top
R37667  10K  [0201]  254.56,41.5 0 top
R37668  10K  [0201]  254.56,42.11 0 top
R37669  10K  [0201]  254.56,42.72 0 top
R37670  10K  [0201]  254.56,43.33 0 top
R37671  10K  [0201]  254.56,43.94 0 top
R37672  10K  [0201]  254.56,44.55 0 top
R37673  10K  [0201]  254.56,45.16 0 top
R37674  10K  [0201]  254.56,45.77 0 top
R37675  10K  [0201]  254.56,46.38 0 top
R37676  10K  [0201]  254.56,46.99 0 top
R37677  10K  [0201]  254.56,47.6 0 top
R37678  10K  [0201]  254.56,48.21 0 top
R37679  10K  [0201]  254.56,48.82 0 top
R37680  10K  [0201]  254.56,49.43 0 top
R37681  10K  [0201]  254.56,50.04 0 top
R37682  10K  [0201]  254.56,50.65 0 top
R37683  10K  [0201]  254.56,51.26 0 top
R37684  10K  [0201]  254.56,51.87 0 top
R37685  10K  [0201]  254.56,52.48 0 top
R37686  10K  [0201]  254.56,53.09 0 top
R37687  10K  [0201]  254.56,53.7 0 top
R37688  10K  [0201]  254.56,54.31 0 top
R37689  10K  [0201]  254.56,54.91 0 top
R37690  10K  [0201]  254.56,55.52 0 top
R37691  10K  [0201]  254.56,56.13 0 top
R37692  10K  [0201]  254.56,56.74 0 top
R37693  10K  [0201]  254.56,57.35 0 top
R37694  10K  [0201]  254.56,57.96 0 top
R37695  10K  [0201]  254.56,58.57 0 top
R37696  10K  [0201]  254.56,59.18 0 top
R37697  10K  [0201]  254.56,59.79 0 top
R37698  10K  [0201]  254.56,60.4 0 top
R37699  10K  [0201]  254.56,61.01 0 top
R37700  10K  [0201]  254.56,61.62 0 top
R37701  10K  [0201]  254.56,62.23 0 top
R37702  10K  [0201]  254.56,62.84 0 top
R37703  10K  [0201]  254.56,63.45 0 top
R37704  10K  [0201]  254.56,64.06 0 top
R37705  10K  [0201]  254.56,64.67 0 top
R37706  10K  [0201]  254.56,65.28 0 top
R37707  10K  [0201]  254.56,65.89 0 top
R37708  10K  [0201]  254.56,66.5 0 top
R37709  10K  [0201]  254.56,67.11 0 top
R37710  10K  [0201]  254.56,67.72 0 top
R37711  10K  [0201]  254.56,68.33 0 top
R37712  10K  [0201]  254.56,68.94 0 top
R37713  10K  [0201]  254.56,69.55 0 top
R37714  10K  [0201]  254.56,70.15 0 top
R37715  10K  [0201]  254.56,70.76 0 top
R37716  10K  [0201]  254.56,71.37 0 top
R37717  10K  [0201]  254.56,71.98 0 top
R37718  10K  [0201]  254.56,72.59 0 top
R37719  10K  [0201]  254.56,73.2 0 top
R37720  10K  [0201]  254.56,73.81 0 top
R37721  10K  [0201]  254.56,74.42 0 top
R37722  10K  [0201]  254.56,75.03 0 top
R37723  10K  [0201]  254.56,75.64 0 top
R37724  10K  [0201]  254.56,76.25 0 top
R37725  10K  [0201]  254.56,76.86 0 top
R37726  10K  [0201]  254.56,77.47 0 top
R37727  10K  [0201]  254.56,78.08 0 top
R37728  10K  [0201]  254.56,78.69 0 top
R37729  10K  [0201]  254.56,79.3 0 top
R37730  10K  [0201]  254.56,79.91 0 top
R37731  10K  [0201]  254.56,80.52 0 top
R37732  10K  [0201]  254.56,81.13 0 top
R37733  10K  [0201]  254.56,81.74 0 top
R37734  10K  [0201]  254.56,82.35 0 top
R37735  10K  [0201]  254.56,82.96 0 top
R37736  10K  [0201]  254.56,83.57 0 top
R37737  10K  [0201]  254.56,84.18 0 top
R37738  10K  [0201]  254.56,84.79 0 top
R37739  10K  [0201]  254.56,85.39 0 top
R37740  10K  [0201]  254.56,86 0 top
R37741  10K  [0201]  254.56,86.61 0 top
R37742  10K  [0201]  254.56,87.22 0 top
R37743  10K  [0201]  254.56,87.83 0 top
R37744  10K  [0201]  254.56,88.44 0 top
R37745  10K  [0201]  254.56,89.05 0 top
R37746  10K  [0201]  254.56,89.66 0 top
R37747  10K  [0201]  254.56,90.27 0 top
R37748  10K  [0201]  254.56,90.88 0 top
R37749  10K  [0201]  254.56,91.49 0 top
R37750  10K  [0201]  254.56,92.1 0 top
R37751  10K  [0201]  254.56,92.71 0 top
R37752  10K  [0201]  254.56,93.32 0 top
R37753  10K  [0201]  254.56,93.93 0 top
R37754  10K  [0201]  254.56,94.54 0 top
R37755  10K  [0201]  254.56,95.15 0 top
R37756  10K  [0201]  254.56,95.76 0 top
R37757  10K  [0201]  254.56,96.37 0 top
R37758  10K  [0201]  254.56,96.98 0 top
R37759  10K  [0201]  254.56,97.59 0 top
R37760  10K  [0201]  254.56,98.2 0 top
R37761  10K  [0201]  254.56,98.81 0 top
R37762  10K  [0201]  254.56,99.42 0 top
R37763  10K  [0201]  254.56,100.03 0 top
R37764  10K  [0201]  254.56,100.63 0 top
R37765  10K  [0201]  254.56,101.24 0 top
R37766  10K  [0201]  254.56,101.85 0 top
R37767  10K  [0201]  254.56,102.46 0 top
R37768  10K  [0201]  254.56,103.07 0 top
R37769  10K  [0201]  254.56,103.68 0 top
R37770  10K  [0201]  254.56,104.29 0 top
R37771  10K  [0201]  254.56,104.9 0 top
R37772  10K  [0201]  254.56,105.51 0 top
R37773  10K  [0201]  254.56,106.12 0 top
R37774  10K  [0201]  254.56,106.73 0 top
R37775  10K  [0201]  254.56,107.34 0 top
R37776  10K  [0201]  254.56,107.95 0 top
R37777  10K  [0201]  254.56,108.56 0 top
R37778  10K  [0201]  254.56,109.17 0 top
R37779  10K  [0201]  254.56,109.78 0 top
R37780  10K  [0201]  254.56,110.39 0 top
R37781  10K  [0201]  254.56,111 0 top
R37782  10K  [0201]  254.56,111.61 0 top
R37783  10K  [0201]  254.56,112.22 0 top
R37784  10K  [0201]  254.56,112.83 0 top
R37785  10K  [0201]  254.56,113.44 0 top
R37786  10K  [0201]  254.56,114.05 0 top
R37787  10K  [0201]  254.56,114.66 0 top
R37788  10K  [0201]  254.56,115.27 0 top
R37789  10K  [0201]  254.56,115.87 0 top
R37790  10K  [0201]  254.56,116.48 0 top
R37791  10K  [0201]  254.56,117.09 0 top
R37792  10K  [0201]  254.56,117.7 0 top
R37793  10K  [0201]  254.56,118.31 0 top
R37794  10K  [0201]  254.56,118.92 0 top
R37795  10K  [0201]  254.56,119.53 0 top
R37796  10K  [0201]  254.56,120.14 0 top
R37797  10K  [0201]  254.56,120.75 0 top
R37798  10K  [0201]  254.56,121.36 0 top
R37799  10K  [0201]  254.56,121.97 0 top
R37800  10K  [0201]  254.56,122.58 0 top
R37801  10K  [0201]  255.78,1.27 0 top
R37802  10K  [0201]  255.78,1.88 0 top
R37803  10K  [0201]  255.78,2.49 0 top
R37804  10K  [0201]  255.78,3.1 0 top
R37805  10K  [0201]  255.78,3.71 0 top
R37806  10K  [0201]  255.78,4.32 0 top
R37807  10K  [0201]  255.78,4.93 0 top
R37808  10K  [0201]  255.78,5.54 0 top
R37809  10K  [0201]  255.78,6.15 0 top
R37810  10K  [0201]  255.78,6.76 0 top
R37811  10K  [0201]  255.78,7.37 0 top
R37812  10K  [0201]  255.78,7.98 0 top
R37813  10K  [0201]  255.78,8.59 0 top
R37814  10K  [0201]  255.78,9.19 0 top
R37815  10K  [0201]  255.78,9.8 0 top
R37816  10K  [0201]  255.78,10.41 0 top
R37817  10K  [0201]  255.78,11.02 0 top
R37818  10K  [0201]  255.78,11.63 0 top
R37819  10K  [0201]  255.78,12.24 0 top
R37820  10K  [0201]  255.78,12.85 0 top
R37821  10K  [0201]  255.78,13.46 0 top
R37822  10K  [0201]  255.78,14.07 0 top
R37823  10K  [0201]  255.78,14.68 0 top
R37824  10K  [0201]  255.78,15.29 0 top
R37825  10K  [0201]  255.78,15.9 0 top
R37826  10K  [0201]  255.78,16.51 0 top
R37827  10K  [0201]  255.78,17.12 0 top
R37828  10K  [0201]  255.78,17.73 0 top
R37829  10K  [0201]  255.78,18.34 0 top
R37830  10K  [0201]  255.78,18.95 0 top
R37831  10K  [0201]  255.78,19.56 0 top
R37832  10K  [0201]  255.78,20.17 0 top
R37833  10K  [0201]  255.78,20.78 0 top
R37834  10K  [0201]  255.78,21.39 0 top
R37835  10K  [0201]  255.78,22 0 top
R37836  10K  [0201]  255.78,22.61 0 top
R37837  10K  [0201]  255.78,23.22 0 top
R37838  10K  [0201]  255.78,23.83 0 top
R37839  10K  [0201]  255.78,24.43 0 top
R37840  10K  [0201]  255.78,25.04 0 top
R37841  10K  [0201]  255.78,25.65 0 top
R37842  10K  [0201]  255.78,26.26 0 top
R37843  10K  [0201]  255.78,26.87 0 top
R37844  10K  [0201]  255.78,27.48 0 top
R37845  10K  [0201]  255.78,28.09 0 top
R37846  10K  [0201]  255.78,28.7 0 top
R37847  10K  [0201]  255.78,29.31 0 top
R37848  10K  [0201]  255.78,29.92 0 top
R37849  10K  [0201]  255.78,30.53 0 top
R37850  10K  [0201]  255.78,31.14 0 top
R37851  10K  [0201]  255.78,31.75 0 top
R37852  10K  [0201]  255.78,32.36 0 top
R37853  10K  [0201]  255.78,32.97 0 top
R37854  10K  [0201]  255.78,33.58 0 top
R37855  10K  [0201]  255.78,34.19 0 top
R37856  10K  [0201]  255.78,34.8 0 top
R37857  10K  [0201]  255.78,35.41 0 top
R37858  10K  [0201]  255.78,36.02 0 top
R37859  10K  [0201]  255.78,36.63 0 top
R37860  10K  [0201]  255.78,37.24 0 top
R37861  10K  [0201]  255.78,37.85 0 top
R37862  10K  [0201]  255.78,38.46 0 top
R37863  10K  [0201]  255.78,39.07 0 top
R37864  10K  [0201]  255.78,39.67 0 top
R37865  10K  [0201]  255.78,40.28 0 top
R37866  10K  [0201]  255.78,40.89 0 top
R37867  10K  [0201]  255.78,41.5 0 top
R37868  10K  [0201]  255.78,42.11 0 top
R37869  10K  [0201]  255.78,42.72 0 top
R37870  10K  [0201]  255.78,43.33 0 top
R37871  10K  [0201]  255.78,43.94 0 top
R37872  10K  [0201]  255.78,44.55 0 top
R37873  10K  [0201]  255.78,45.16 0 top
R37874  10K  [0201]  255.78,45.77 0 top
R37875  10K  [0201]  255.78,46.38 0 top
R37876  10K  [0201]  255.78,46.99 0 top
R37877  10K  [0201]  255.78,47.6 0 top
R37878  10K  [0201]  255.78,48.21 0 top
R37879  10K  [0201]  255.78,48.82 0 top
R37880  10K  [0201]  255.78,49.43 0 top
R37881  10K  [0201]  255.78,50.04 0 top
R37882  10K  [0201]  255.78,50.65 0 top
R37883  10K  [0201]  255.78,51.26 0 top
R37884  10K  [0201]  255.78,51.87 0 top
R37885  10K  [0201]  255.78,52.48 0 top
R37886  10K  [0201]  255.78,53.09 0 top
R37887  10K  [0201]  255.78,53.7 0 top
R37888  10K  [0201]  255.78,54.31 0 top
R37889  10K  [0201]  255.78,54.91 0 top
R37890  10K  [0201]  255.78,55.52 0 top
R37891  10K  [0201]  255.78,56.13 0 top
R37892  10K  [0201]  255.78,56.74 0 top
R37893  10K  [0201]  255.78,57.35 0 top
R37894  10K  [0201]  255.78,57.96 0 top
R37895  10K  [0201]  255.78,58.57 0 top
R37896  10K  [0201]  255.78,59.18 0 top
R37897  10K  [0201]  255.78,59.79 0 top
R37898  10K  [0201]  255.78,60.4 0 top
R37899  10K  [0201]  255.78,61.01 0 top
R37900  10K  [0201]  255.78,61.62 0 top
R37901  10K  [0201]  255.78,62.23 0 top
R37902  10K  [0201]  255.78,62.84 0 top
R37903  10K  [0201]  255.78,63.45 0 top
R37904  10K  [0201]  255.78,64.06 0 top
R37905  10K  [0201]  255.78,64.67 0 top
R37906  10K  [0201]  255.78,65.28 0 top
R37907  10K  [0201]  255.78,65.89 0 top
R37908  10K  [0201]  255.78,66.5 0 top
R37909  10K  [0201]  255.78,67.11 0 top
R37910  10K  [0201]  255.78,67.72 0 top
R37911  10K  [0201]  255.78,68.33 0 top
R37912  10K  [0201]  255.78,68.94 0 top
R37913  10K  [0201]  255.78,69.55 0 top
R37914  10K  [0201]  255.78,70.15 0 top
R37915  10K  [0201]  255.78,70.76 0 top
R37916  10K  [0201]  255.78,71.37 0 top
R37917  10K  [0201]  255.78,71.98 0 top
R37918  10K  [0201]  255.78,72.59 0 top
R37919  10K  [0201]  255.78,73.2 0 top
R37920  10K  [0201]  255.78,73.81 0 top
R37921  10K  [0201]  255.78,74.42 0 top
R37922  10K  [0201]  255.78,75.03 0 top